# EasyEDA Pro project Access Control V2.1.eprj, board V2.0.1 USB PCB
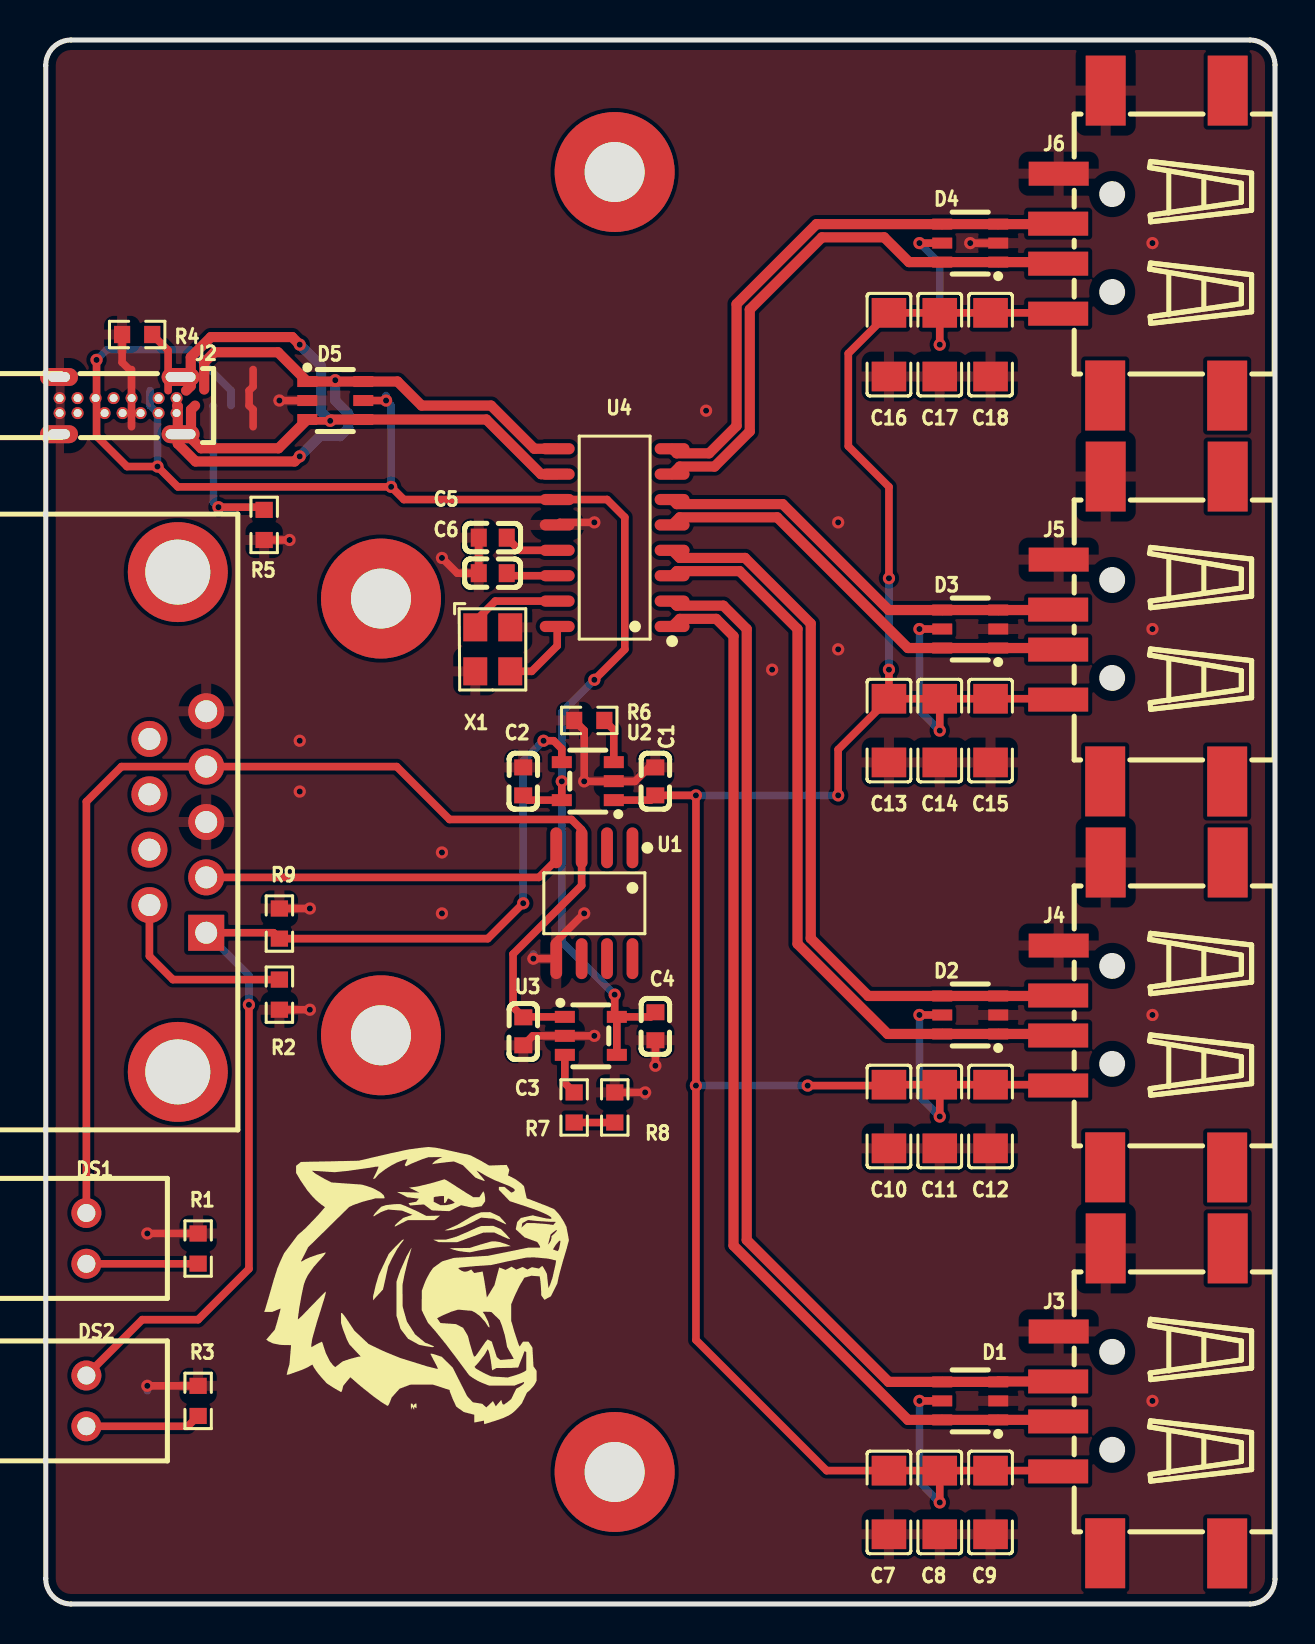
[diagram p6: board, top side]
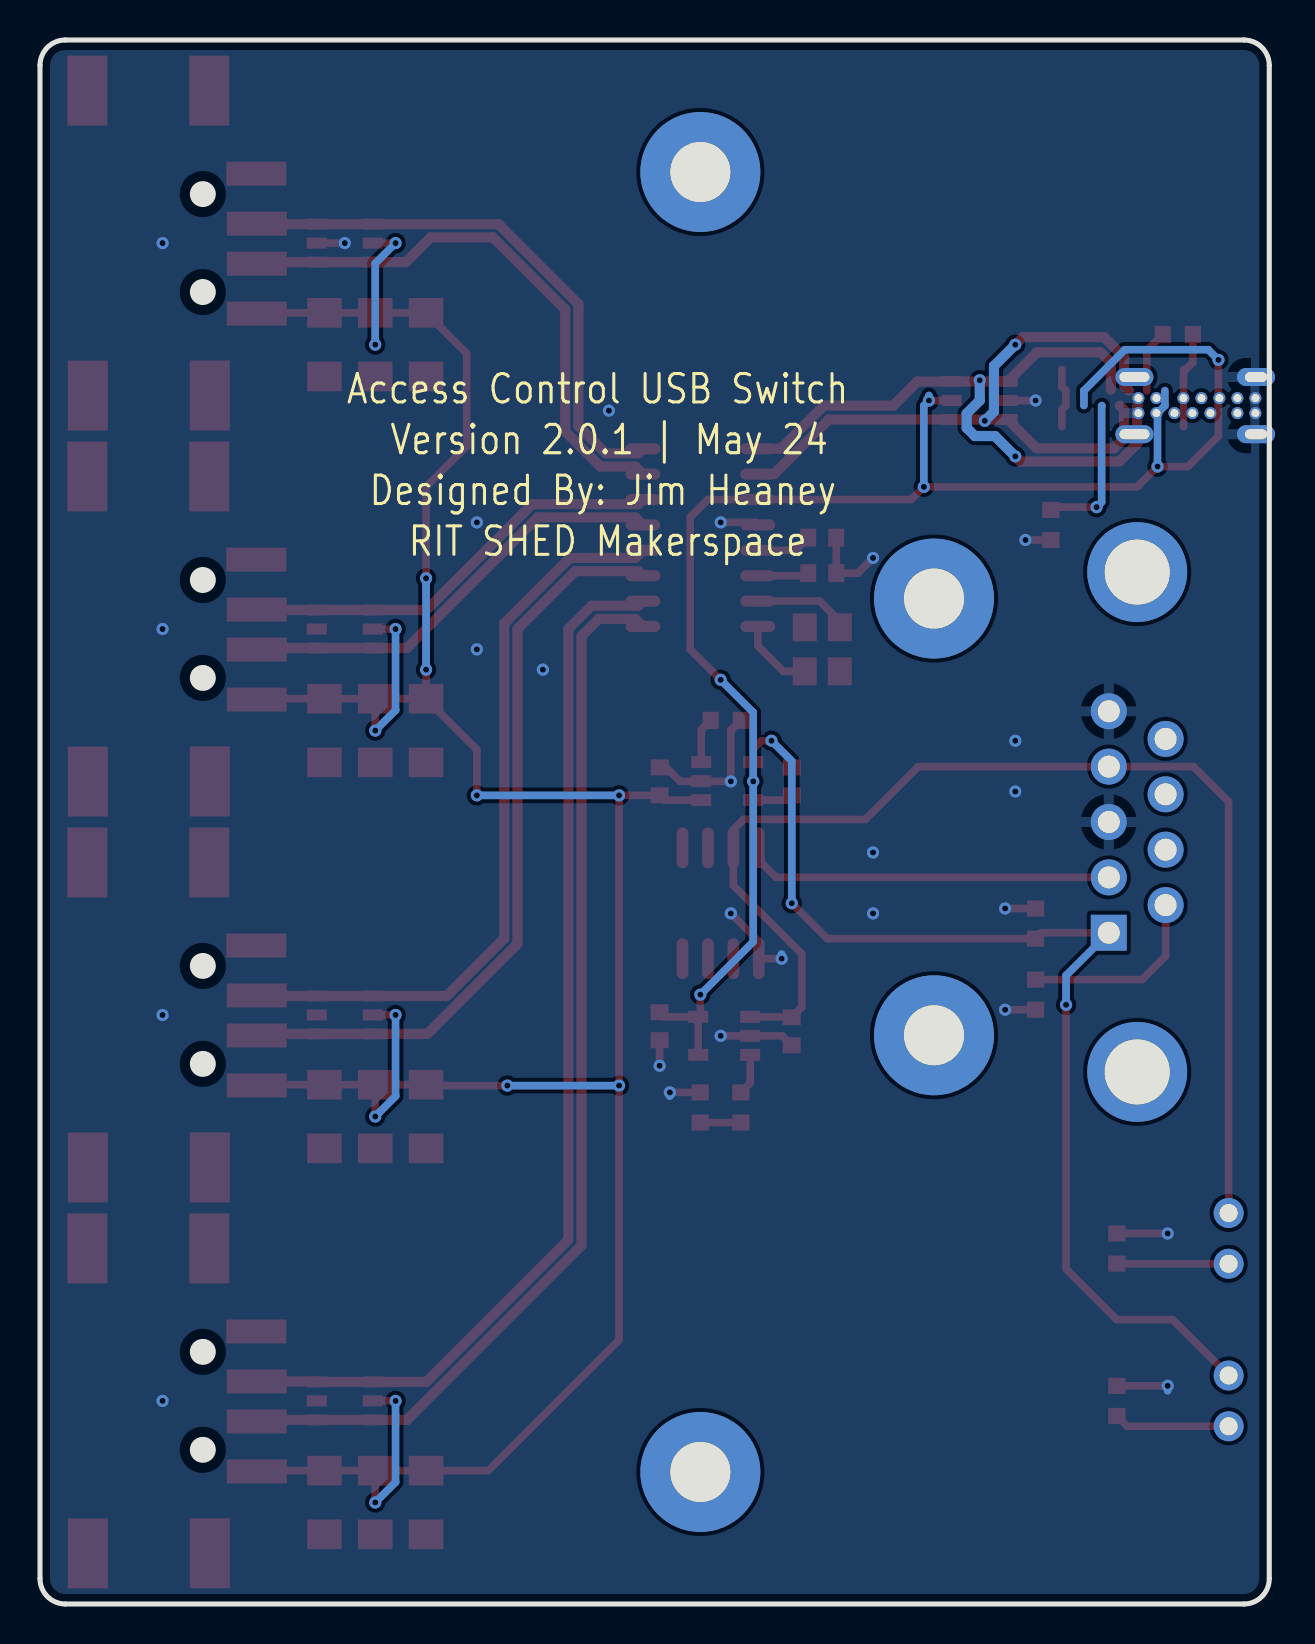
[diagram p7: board, bottom side, seen from below]

Outline 61.47 x 78.23 mm; copper layers: Top Layer, Bottom Layer. Coordinates in mm from the lower left corner of the outline.
Outline path: 0,76.96 0,1.27 arc(0.37,0.37) 1.27,0 60.2,0 arc(61.1,0.37) 61.47,1.27 61.47,76.96 arc(61.1,77.86) 60.2,78.23 1.27,78.23 arc(0.37,77.86) 0,76.96
Stack: Top Layer 0.035mm / Dielectric1 1.51mm FR4 er 4.5 / Bottom Layer 0.035mm

## Design rules (mm)
net D-1: D1
net D+1: D1
net D-2: D2
net D+2: D2
net D-3: D3
net D+3: D3
net D-4: D4
net D+4: D4
net D+: D0
net D-: D0
template: JLCPCB Capability(Two Layers Board)
spacing copperThickness1oz (default): track to track 0.102, other pairs 0.152 to 0.3
spacing copperThickness2oz: track to track 0.203, other pairs 0.152 to 0.3
track width copperThickness1oz (default): min 0.127, default 0.254, max 2.54
track width copperThickness2oz: min 0.203, default 0.254, max 2.54
differential pair differentialPair (default): width min 0.127, default 0.254, max 2.54; gap min 0.152, default 0.152
via viaSize (default): diameter min 0.5, default 0.61, max 10; hole min 0.3, default 0.305, max 6.3

## Placement (name value [footprint] x y rotation side)
C1  10uF  [C0603]  30.48 41.15 270 top
C2  10uF  [C0603]  23.88 41.15 270 top
C3  10uF  [C0603]  23.88 28.65 90 top
C4  10uF  [C0603]  30.49 28.9 90 top
C5  10uF  [C0603]  22.35 53.34 0 top
C6  10uF  [C0603]  22.35 51.56 0 top
C7  47uF  [C1206]  42.16 5.08 90 top
C8  47uF  [C1206]  44.7 5.08 90 top
C9  47uF  [C1206]  47.24 5.08 90 top
C10  47uF  [C1206]  42.16 24.38 90 top
C11  47uF  [C1206]  44.7 24.38 90 top
C12  47uF  [C1206]  47.24 24.38 90 top
C13  47uF  [C1206]  42.16 43.69 90 top
C14  47uF  [C1206]  44.7 43.69 90 top
C15  47uF  [C1206]  47.24 43.69 90 top
C16  47uF  [C1206]  42.16 62.99 90 top
C17  47uF  [C1206]  44.7 62.99 90 top
C18  47uF  [C1206]  47.24 62.99 90 top
D1  SRV05-4-P-T7  [SOT-23-6_L2.9-W1.6-P0.95-LS2.8-BR]  46.23 10.16 0 top
D2  SRV05-4-P-T7  [SOT-23-6_L2.9-W1.6-P0.95-LS2.8-BR]  46.23 29.46 0 top
D3  SRV05-4-P-T7  [SOT-23-6_L2.9-W1.6-P0.95-LS2.8-BR]  46.23 48.77 0 top
D4  SRV05-4-P-T7  [SOT-23-6_L2.9-W1.6-P0.95-LS2.8-BR]  46.23 68.07 0 top
D5  SRV05-4-P-T7  [SOT-23-6_L2.9-W1.6-P0.95-LS2.8-BR]  14.48 60.2 180 top
DS1  MHK1560CRBTD  [LED-TH_MHK1560UGBTD]  2.03 18.29 270 top
DS2  MHK1560UGBTD  [LED-TH_MHK1560UGBTD]  2.03 10.16 270 top
J1  D-SUB-DR-9PCM-CB  [DB9-TH_ID09S33E4GV00LF]  6.6 39.12 270 top
J2  XUBF-0314-0907  [TYPE-C-TH_TYPE-C-14P-CC-2.6]  4.32 59.94 270 top
J3  AF 10.0 QT-ZB6.8  [USB-A-SMD_AF-10.0-QT-ZB6.8]  54.86 10.16 90 top
J4  AF 10.0 QT-ZB6.8  [USB-A-SMD_AF-10.0-QT-ZB6.8]  54.86 29.46 90 top
J5  AF 10.0 QT-ZB6.8  [USB-A-SMD_AF-10.0-QT-ZB6.8]  54.86 48.77 90 top
J6  AF 10.0 QT-ZB6.8  [USB-A-SMD_AF-10.0-QT-ZB6.8]  54.86 68.07 90 top
NOREF  -  [Pad_e415]  16.76 50.29 0 top
NOREF#2  -  [Pad_e915]  28.45 71.63 0 top
NOREF#3  -  [Pad_e414]  16.76 28.45 0 top
NOREF#4  -  [Pad_e413]  28.45 6.6 0 top
R1  1kΩ  [R0603]  7.62 17.78 90 top
R2  6.8kΩ  [R0603]  11.68 30.48 90 top
R3  1kΩ  [R0603]  7.62 10.16 90 top
R4  5.1kΩ  [R0603]  4.57 63.5 0 top
R5  5.1kΩ  [R0603]  10.92 53.97 90 top
R6  6.8kΩ  [R0603]  27.18 44.2 180 top
R7  6.8kΩ  [R0603]  26.42 24.84 270 top
R8  6.8kΩ  [R0603]  28.45 24.84 90 top
R9  6.8kΩ  [R0603]  11.68 34.04 270 top
U1  DS18B20Z+T&R  [SOIC-8_L4.9-W3.9-P1.27-LS6.0-BL]  27.43 35.05 180 top
U2  MT9700  [SOT-23-5_L3.0-W1.7-P0.95-LS2.8-BR]  27.1 41.16 0 top
U3  MT9700  [SOT-23-5_L3.0-W1.7-P0.95-LS2.8-BR]  27.26 28.42 180 top
U4  SL2.1A  [SOP-16_L10.0-W3.9-P1.27-LS6.0-BL]  28.45 53.34 90 top
X1  12MHz  [OSC-SMD_4P-L3.2-W2.5-BL]  22.35 47.75 270 top

## Footprints (pads in the part's own frame, mm; a bottom-side part is the same pattern mirrored in y, then rotated)
C0603
  rect 0.8x0.9 smd: 1(-0.7,0) 2(0.7,0)
C1206
  rect 1.485x1.728 smd: 1(-1.593,0) 2(1.593,0)
DB9-TH_ID09S33E4GV00LF
  rect 1.8x1.8 hole 1.1: 1(5.54,1.42)
  round 1.8 hole 1.1: 2(2.77,1.42) 3(0,1.42) 4(-2.77,1.42) 5(-5.54,1.42) 6(4.155,-1.42) 7(1.385,-1.42) 8(-1.385,-1.42) 9(-4.155,-1.42)
  round 5 hole 3.25: 10(-12.5,0) 11(12.5,0)
LED-TH_MHK1560UGBTD
  round 1.5 hole 0.9: 1(1.27,0) 2(-1.27,0)
OSC-SMD_4P-L3.2-W2.5-BL
  rect 1.4x1.2 smd: 1(-1.1,-0.875) 2(1.1,-0.875) 3(1.1,0.875) 4(-1.1,0.875)
Pad_e413
  round 6 hole 3: 17(0,0)
Pad_e414
  round 6 hole 3: 17(0,0)
Pad_e415
  round 6 hole 3: 17(0,0)
Pad_e915
  round 6 hole 3: 17(0,0)
R0603
  rect 0.806x0.864 smd: 1(-0.753,0) 2(0.753,0)
SOIC-8_L4.9-W3.9-P1.27-LS6.0-BL
  oval 0.588x2.045 smd: 1(-1.905,-2.772) 2(-0.635,-2.772) 3(0.635,-2.772) 4(1.905,-2.772) 5(1.905,2.772) 6(0.635,2.772) 7(-0.635,2.772) 8(-1.905,2.772)
SOP-16_L10.0-W3.9-P1.27-LS6.0-BL
  oval 0.56x1.745 smd: 1(-4.445,-2.873) 2(-3.175,-2.873) 3(-1.905,-2.873) 4(-0.635,-2.873) 5(0.635,-2.873) 6(1.905,-2.873) 7(3.175,-2.873) 8(4.445,-2.873) 9(4.445,2.873) 10(3.175,2.873) 11(1.905,2.873) 12(0.635,2.873) 13(-0.635,2.873) 14(-1.905,2.873) 15(-3.175,2.873) 16(-4.445,2.873)
SOT-23-5_L3.0-W1.7-P0.95-LS2.8-BR
  rect 1x0.6 smd: 1(1.3,-0.95) 2(1.3,0) 3(1.3,0.95) 4(-1.3,0.95) 5(-1.3,-0.95)
SOT-23-6_L2.9-W1.6-P0.95-LS2.8-BR
  rect 1x0.55 smd: 1(1.4,-0.95) 2(1.4,0) 3(1.4,0.95) 4(-1.4,0.95) 5(-1.4,0) 6(-1.4,-0.95)
TYPE-C-TH_TYPE-C-14P-CC-2.6
  round 0.6 hole 0.4x0.42: A1(0.375,2.225) A4(0.375,1.325) A5(0.375,0.425) A6(0.375,-0.475) A7(0.375,-1.375) A9(0.375,-2.725) A12(0.375,-3.625) B1(-0.375,-3.625) B4(-0.375,-2.725) B5(-0.375,-1.825) B6(-0.375,-0.925) B7(-0.375,-0.025) B9(-0.375,1.325) B12(-0.375,2.225)
  oval 0.9x1.9 hole 0.5x1.5: SH1(1.43,2.425) SH2(-1.43,2.425)
  oval 0.9x1.9 hole 0.5x1.1: SH1(1.43,-3.655) SH2(-1.43,-3.655)
USB-A-SMD_AF-10.0-QT-ZB6.8
  rect 1.2x3 smd: 1(-3.528,4.237) 2(-1.028,4.237) 3(0.972,4.237) 4(3.472,4.213)
  rect 3.5x2 smd: 5(-7.628,-4.213) 5(-7.622,1.887) 5(7.628,1.863) 5(7.628,-4.237)

## Nets
As in the schematic.

Pads without a net: J1 7 8 9 10 11; NOREF 17; NOREF#2 17; NOREF#3 17; NOREF#4 17; U1 1 2 6 7 8

## Via types
v1: diameter 0.61, hole 0.305, Top Layer to Bottom Layer, 56 vias

## Routing (per net, layer and track width the routed paths; a pad name or vN(x,y) marks a point on that pad's centre or on a via; arc(x,y) is an arc through that point)
GND: length 44.3
  Top Layer w0.381: 28.42,41.15 29.46,41.15 30.16,41.85 C1.1 ; 28.42,41.15 v1(26.92,41.15) 26.92,43.7 R6.2 ; 28.42,41.15 U2.2 ; C4.1 v1(30.49,26.92) ; v1(24.38,32.28) U1.5 25.53,33.15 v1(26.92,34.54) ; 4.22,61.71 3.82,62.11 R4.1 ; R9.1 v1(13.21,34.79) ; C3.1 24.35,28.42 U3.2 v1(27.43,28.42) ; R2.1 v1(13.21,29.73) ; 10.37,58.89 10.37,59.74 10.17,59.94 10.17,60.69 10.37,60.89 10.37,61.75 ; v1(19.81,52.32) 20.57,51.56 C6.1 C5.1 ; U4.12 25.7,54.1 v1(27.43,54.1) ; R3.2 v1(5.08,10.91) ; D4.2 v1(46.23,68.07) ; R1.2 v1(5.08,18.53) ; D5.2 v1(11.68,60.2) ; 4.29,61.75 4.29,58.89 ; R5.1 v1(12.19,53.22) ; R8.2 v1(29.97,25.59)
  Bottom Layer w0.381: v1(5.08,10.91) 5.08,10.67 ; v1(29.97,25.59) 29.97,25.4 ; v1(12.19,53.22) 12.19,53.34 ; v1(24.38,32.28) 24.38,32.51
  vias: v1(12.7,43.18) v1(12.7,40.64) v1(19.81,37.59) v1(19.81,34.54) v1(33.02,59.69) v1(36.32,46.74) v1(39.62,54.1) v1(39.62,47.75) v1(55.34,68.07) v1(55.34,48.77) v1(55.34,29.46) v1(55.34,10.16)
VIN: length 84.5
  Top Layer w0.381: v1(2.54,62.23) 2.54,58.42 4.06,56.9 v1(5.59,56.9) 6.6,55.88 v1(17.27,55.88) 17.91,55.24 U4.11 28.07,55.24 28.96,54.36 28.96,47.75 v1(27.43,46.23) ; C2.2 24.11,40.21 U2.5 v1(25.8,41.15) ; 28.56,29.37 28.45,29.48 v1(28.45,30.48) ; 28.56,29.37 30.25,29.37 C4.2 ; 28.56,29.37 28.56,27.47 ; D5.5 v1(17.02,60.2)
  Bottom Layer w0.381: v1(5.59,56.9) 5.59,59.57 5.22,59.94 5.22,60.69 ; v1(28.45,30.48) 25.8,33.12 v1(25.8,41.15) 25.8,44.6 v1(27.43,46.23) ; 17.02,60.45 v1(17.02,60.2) 17.27,59.94 v1(17.27,55.88) ; 9.27,59.94 9.27,60.69 7.22,62.74 3.05,62.74 v1(2.54,62.23)
D+: length 34.2
  Top Layer w0.381: D5.3 13.14,59.18 v1(14.22,59.18)
  Top Layer w0.508: 7.02,60.69 7.25,60.93 7.25,62.36 8.26,63.37 12.32,63.37 v1(12.7,62.99) ; D5.3 11.64,57.81 7.77,57.81 7.26,58.31 7.26,59.74 7.47,59.94 ; U4.10 24.76,56.51 22.03,59.25 D5.4 14.29,59.25 v1(14.22,59.18)
  Bottom Layer w0.508: v1(12.7,62.99) 13.77,61.93 13.77,59.64 v1(14.22,59.18)
D+1: length 53.4
  Top Layer w0.508: J3.3 47.65,11.13 D1.3 D1.4 42.15,11.11 35.05,18.21 35.05,48.77 33.88,49.94 31.55,49.94 U4.2
D+2: length 37.8
  Top Layer w0.508: J4.3 50.6,30.41 D2.3 D2.4 41.13,30.41 38.25,33.29 38.25,49.04 34.97,52.32 31.7,52.32 U4.4
D+3: length 21.6
  Top Layer w0.508: J5.3 50.6,49.72 D3.3 D3.4 42.15,49.72 36.85,55.02 31.55,55.02 U4.6
D+4: length 27.7
  Top Layer w0.508: U4.8 31.55,57.56 33.17,57.56 34.54,58.93 34.54,65.02 38.54,69.02 D4.4 D4.3 50.6,69.02 J6.3
D-: length 35.4
  Top Layer w0.508: 7.92,60.75 7.92,62.1 8.43,62.61 11.61,62.61 D5.1 14.41,61.15 v1(14.48,61.21) 14.54,61.15 D5.6 17.59,61.15 18.8,59.94 22.27,59.94 24.43,57.78 U4.9 ; v1(12.7,57.4) 12.45,57.15 7.49,57.15 6.6,58.04 6.6,59.91 6.57,59.94
  Bottom Layer w0.508: v1(12.7,57.4) 13.72,58.42 14.72,58.42 15.13,58.83 15.13,59.55 14.48,60.2 v1(14.48,61.21)
D-1: length 53.9
  Top Layer w0.508: J3.2 50.55,9.21 D1.1 D1.6 43.11,9.21 34.39,17.93 34.39,48.41 33.53,49.28 31.7,49.28 31.32,48.89
D-2: length 38.2
  Top Layer w0.508: J4.2 50.55,28.51 D2.1 D2.6 42.1,28.51 37.59,33.02 37.59,48.77 34.7,51.66 31.55,51.66 U4.3
D-3: length 22.2
  Top Layer w0.508: U4.5 31.7,54.36 36.58,54.36 43.11,47.82 D3.6 D3.1 50.55,47.82 J5.2
D-4: length 28.3
  Top Layer w0.508: J6.2 50.55,67.12 D4.1 D4.6 43.16,67.12 41.92,68.36 38.82,68.36 35.2,64.75 35.2,58.65 33.45,56.9 31.7,56.9 U4.7
NO: length 55
  Top Layer w0.381: v1(24.89,43.18) 25.4,43.18 25.8,42.78 U2.4 ; v1(23.88,35.05) 22.11,33.28 R9.2 11.39,33.58 J1.1 ; v1(10.16,29.97) 10.16,16.76 7.62,14.22 4.83,14.22 DS2.2
  Bottom Layer w0.381: v1(24.89,43.18) 23.88,42.16 v1(23.88,35.05) ; J1.1 10.16,31.44 v1(10.16,29.97)
TEMP: length 18.5
  Top Layer w0.381: U1.4 25.53,37.21 24.66,36.35 J1.2
VDS: length 154.3
  Top Layer w0.381: C17.2 C18.2 50.59,64.58 J6.1 ; C17.2 v1(44.7,62.99) ; C17.2 C16.2 40.13,62.55 40.13,57.91 42.16,55.88 v1(42.16,51.31) ; C13.2 v1(42.16,46.74) ; C13.2 C14.2 ; C13.2 39.62,42.74 v1(39.62,40.45) ; C8.2 C9.2 50.59,6.67 J3.1 ; C8.2 v1(44.7,5.08) ; C8.2 C7.2 39.05,6.67 32.51,13.21 v1(32.51,25.93) v1(32.51,40.45) C1.2 30.24,40.21 U2.1 ; C11.2 C10.2 42.12,25.93 v1(38.1,25.93) ; C11.2 v1(44.7,24.38) ; C11.2 C12.2 50.59,25.98 J4.1 ; D3.5 v1(43.69,48.77) ; C14.2 C15.2 50.59,45.28 J5.1 ; C14.2 v1(44.7,43.69) ; D1.5 v1(43.69,10.16) ; D2.5 v1(43.69,29.46) ; D4.5 v1(43.69,68.07)
  Bottom Layer w0.381: v1(44.7,24.38) 43.69,25.4 v1(43.69,29.46) ; v1(43.69,48.77) 43.69,44.7 v1(44.7,43.69) ; v1(43.69,68.07) 44.7,67.06 v1(44.7,62.99) ; v1(43.69,10.16) 43.69,6.1 v1(44.7,5.08) ; v1(32.51,40.45) v1(39.62,40.45) ; v1(32.51,25.93) v1(38.1,25.93) ; v1(42.16,46.74) v1(42.16,51.31)
VSW: length 60.5
  Top Layer w0.381: U3.1 23.9,29.37 C3.2 23.37,29.86 23.37,32.51 26.8,35.94 U1.3 26.8,38.73 26.29,39.24 20.19,39.24 17.55,41.89 J1.4 3.79,41.89 2.03,40.13 DS1.2
$1N967: length 3.8
  Top Layer w0.381: X1.3 24.3,46.65 25.58,47.93 25.58,48.89
$1N968: length 4.8
  Top Layer w0.381: U4.15 22.48,50.16 21.48,49.16 X1.1
$1N970: length 2.8
  Top Layer w0.381: C5.2 23.69,52.7 U4.13
$1N972: length 2.6
  Top Layer w0.381: U4.14 23.18,51.43 C6.2
$1N1229: length 2.1
  Top Layer w0.381: U3.3 25.96,26.05 R7.1
$1N1238: length 2
  Top Layer w0.381: 26.42,24.08 28.45,24.08
$1N1555: length 2.3
  Top Layer w0.381: U2.3 28.4,43.72 R6.1
$1N8715: length 9.5
  Top Layer w0.381: R2.2 6.36,31.23 5.18,32.41 J1.6
$1N13558: length 5.8
  Top Layer w0.381: R3.1 7.1,8.89 DS2.1
$1N13598: length 5.6
  Top Layer w0.381: R1.1 7.61,17.02 DS1.1
$1N16584: length 7.5
  Top Layer w0.381: v1(8.64,54.86) 10.79,54.86 R5.2
  Bottom Layer w0.381: v1(8.64,54.86) 8.38,55.12 8.38,59.93 8.37,59.94
$1N16606: length 3.1
  Top Layer w0.381: 6.12,60.69 6.12,62.71 R4.2

## Copper pours and planes (outline as drawn; the poured copper is in the pictures)
GND on Top Layer: -2.03,85.34 64.01,85.34 64.01,-12.19 -2.03,-12.19
GND on Bottom Layer: -11.68,79.76 74.17,79.76 74.17,-1.52 -11.68,-1.52

## Text on the board
Bottom Silkscreen Layer: RIT SHED Makerspace | Version 2.0.1 | May 24 | Designed By: Jim Heaney | Access Control USB Switch
